# Altium schematic sheet 0016_Processor - PM , C.SchDoc
size A2
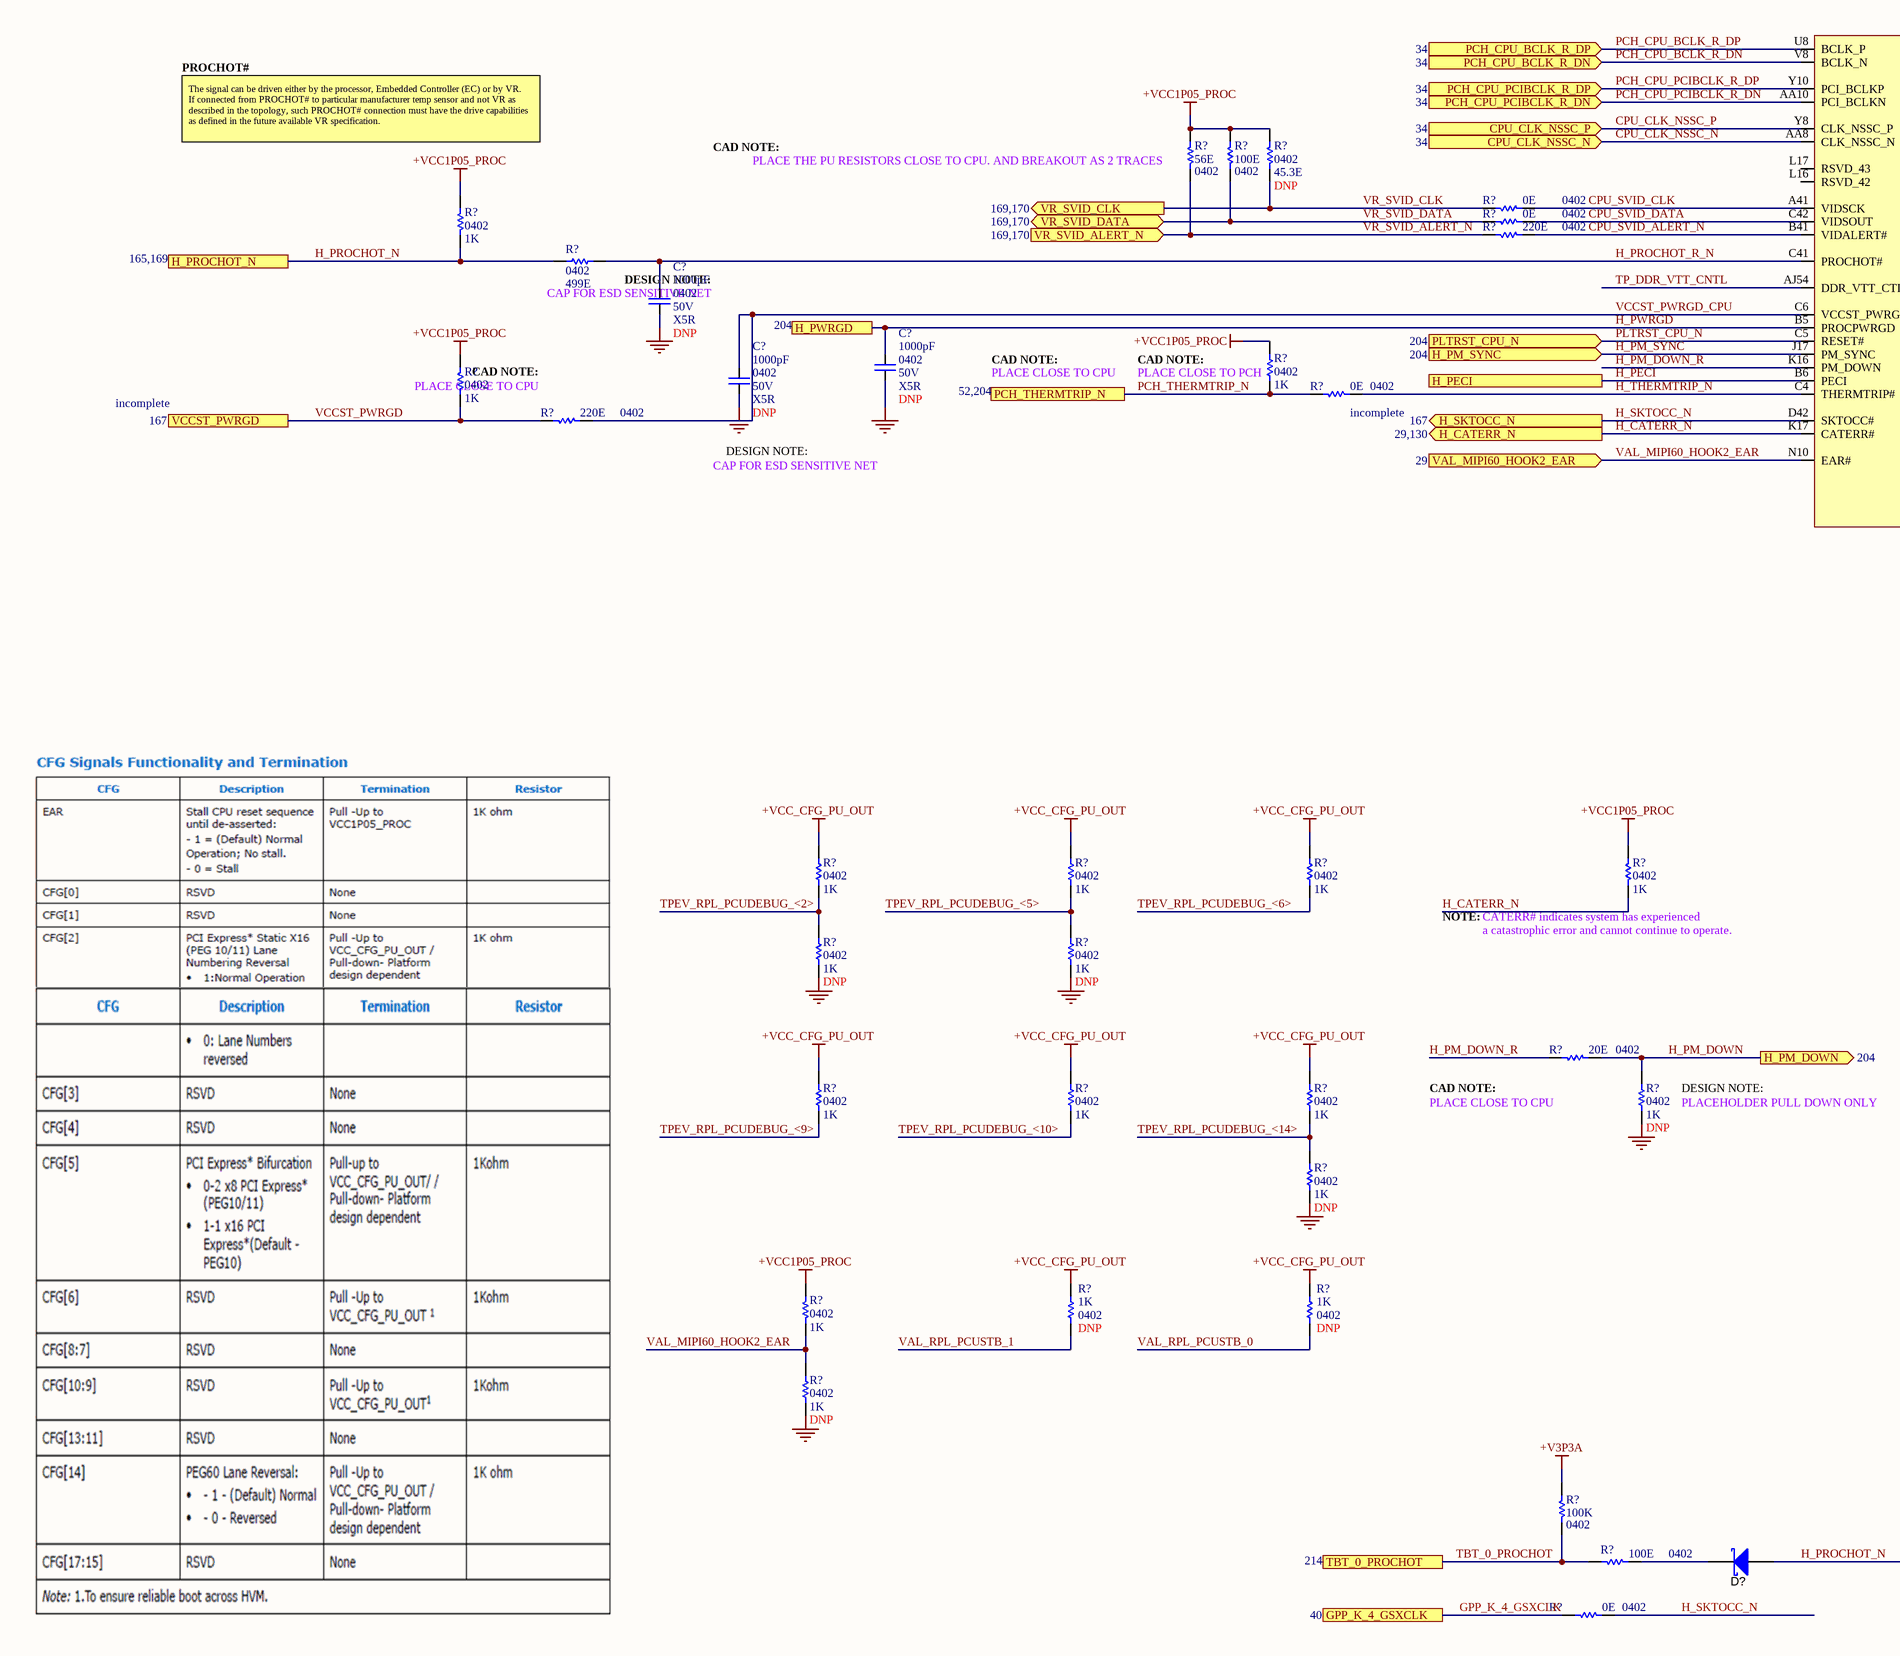
[diagram p0: 0016_Processor - PM , C.SchDoc, left]
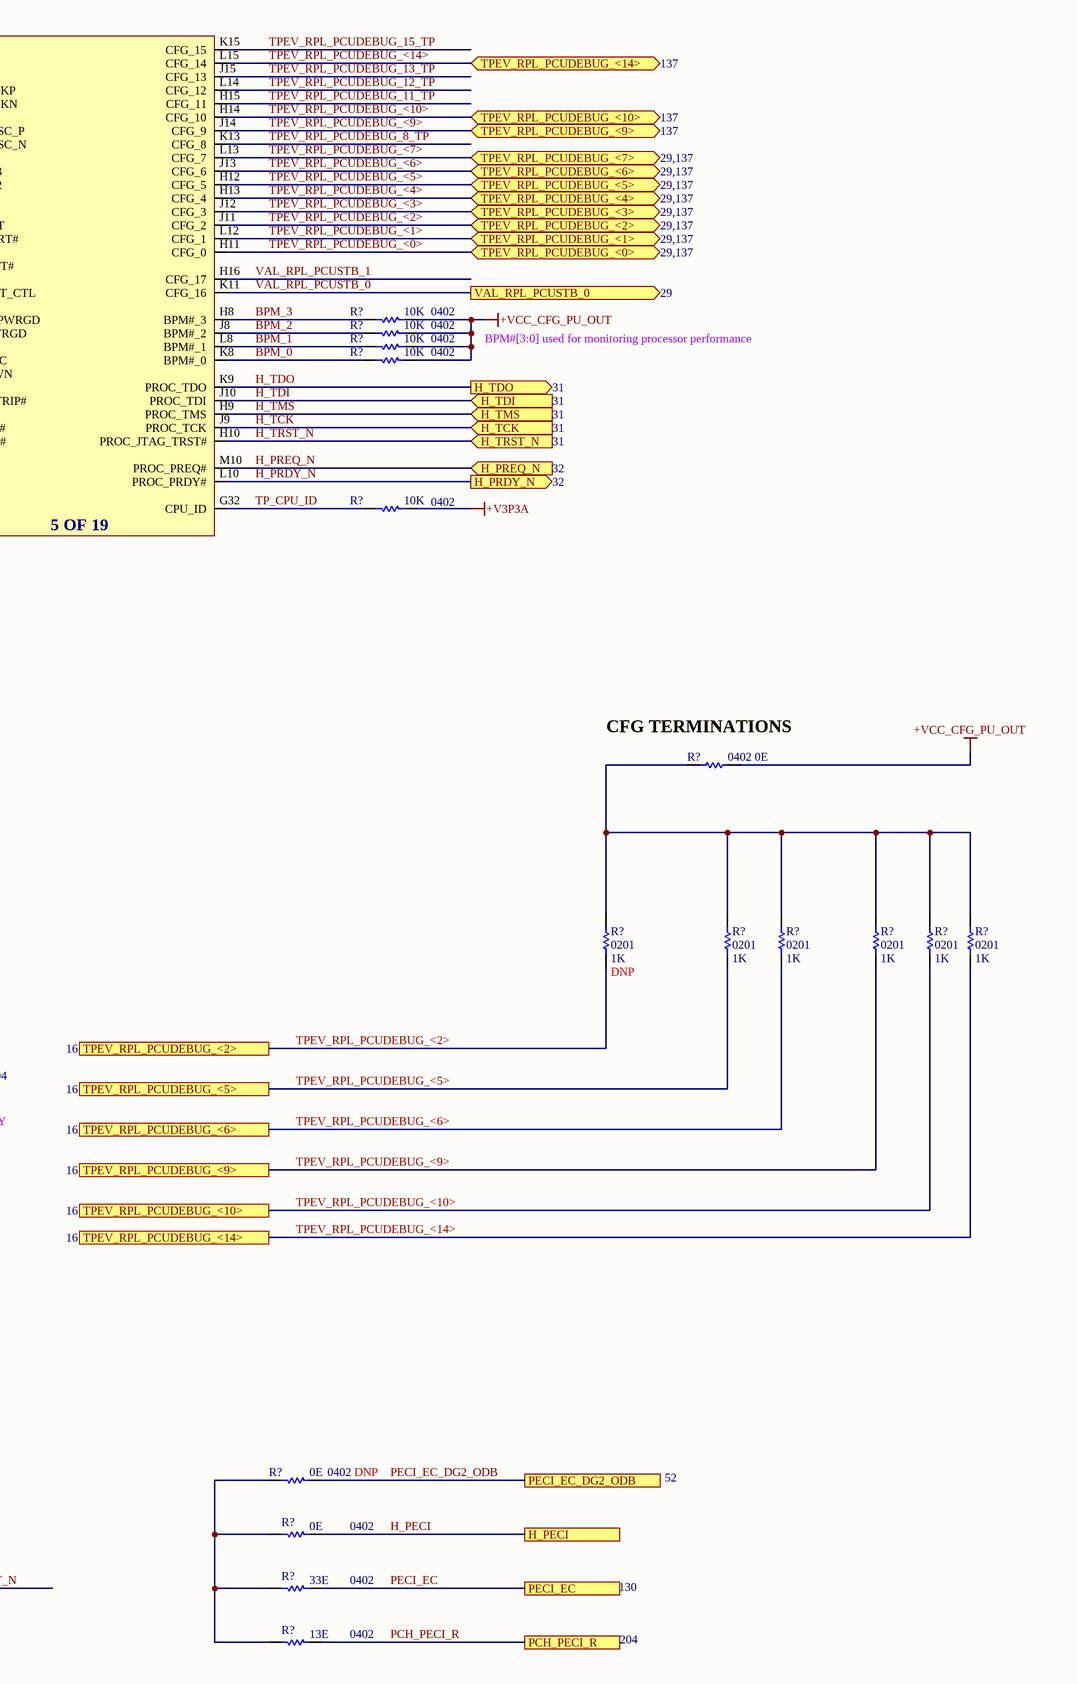
[diagram p1: 0016_Processor - PM , C.SchDoc, right]

## Parts
(Parts that share a designator on the sheet are numbered #1, #2 ... from top to bottom, then left to right.)
C?#1  value 1000pF  Case/Package: 0402  Voltage: 50V  Dielectric: X5R  [CAPC0402]
C?#2  value 1000pF  Case/Package: 0402  Voltage: 50V  Dielectric: X5R  [CAPC0402]
C?#3  value 1000pF  Case/Package: 0402  Voltage: 50V  Dielectric: X5R  [CAPC0402]
D?  SCHOTTKY  (value not drawn)
R?#1  value 56E  Case/Package: 0402  [RESC0402]  (hidden comment: Res)
R?#2  value 100E  Case/Package: 0402  [RESC0402]  (hidden comment: Res)
R?#3  value 45.3E  Case/Package: 0402  [RESC0402]  (hidden comment: Res)
R?#4  value 0E  Case/Package: 0402  [RESC0402]  (hidden comment: Res)
R?#5  value 1K  Case/Package: 0402  [RESC0402]  (hidden comment: Res)
R?#6  value 0E  Case/Package: 0402  [RESC0402]  (hidden comment: Res)
R?#7  value 220E  Case/Package: 0402  [RESC0402]  (hidden comment: Res)
R?#8  value 499E  Case/Package: 0402  [RESC0402]  (hidden comment: Res)
R?#9  value 10K  Case/Package: 0402  [RESC0402]  (hidden comment: Res)
R?#10  value 10K  Case/Package: 0402  [RESC0402]  (hidden comment: Res)
R?#11  value 10K  Case/Package: 0402  [RESC0402]  (hidden comment: Res)
R?#12  value 10K  Case/Package: 0402  [RESC0402]  (hidden comment: Res)
R?#13  value 1K  Case/Package: 0402  [RESC0402]  (hidden comment: Res)
R?#14  value 1K  Case/Package: 0402  [RESC0402]  (hidden comment: Res)
R?#15  value 0E  Case/Package: 0402  [RESC0402]  (hidden comment: Res)
R?#16  value 220E  Case/Package: 0402  [RESC0402]  (hidden comment: Res)
R?#17  value 10K  Case/Package: 0402  [RESC0402]  (hidden comment: Res)
R?#18  value 0E  Case/Package: 0402  [RESC0402]  (hidden comment: Res)
R?#19  value 1K  Case/Package: 0402  [RESC0402]  (hidden comment: Res)
R?#20  value 1K  Case/Package: 0402  [RESC0402]  (hidden comment: Res)
R?#21  value 1K  Case/Package: 0402  [RESC0402]  (hidden comment: Res)
R?#22  value 1K  Case/Package: 0402  [RESC0402]  (hidden comment: Res)
R?#23  value 1K  Case/Package: 0201  [RESC0201]  (hidden comment: Res)
R?#24  value 1K  Case/Package: 0201  [RESC0201]  (hidden comment: Res)
R?#25  value 1K  Case/Package: 0201  [RESC0201]  (hidden comment: Res)
R?#26  value 1K  Case/Package: 0201  [RESC0201]  (hidden comment: Res)
R?#27  value 1K  Case/Package: 0201  [RESC0201]  (hidden comment: Res)
R?#28  value 1K  Case/Package: 0201  [RESC0201]  (hidden comment: Res)
R?#29  value 1K  Case/Package: 0402  [RESC0402]  (hidden comment: Res)
R?#30  value 1K  Case/Package: 0402  [RESC0402]  (hidden comment: Res)
R?#31  value 20E  Case/Package: 0402  [RESC0402]  (hidden comment: Res)
R?#32  value 1K  Case/Package: 0402  [RESC0402]  (hidden comment: Res)
R?#33  value 1K  Case/Package: 0402  [RESC0402]  (hidden comment: Res)
R?#34  value 1K  Case/Package: 0402  [RESC0402]  (hidden comment: Res)
R?#35  value 1K  Case/Package: 0402  [RESC0402]  (hidden comment: Res)
R?#36  value 1K  Case/Package: 0402  [RESC0402]  (hidden comment: Res)
R?#37  value 1K  Case/Package: 0402  [RESC0402]  (hidden comment: Res)
R?#38  value 1K  Case/Package: 0402  [RESC0402]  (hidden comment: Res)
R?#39  value 1K  Case/Package: 0402  [RESC0402]  (hidden comment: Res)
R?#40  value 1K  Case/Package: 0402  [RESC0402]  (hidden comment: Res)
R?#41  value 0E  Case/Package: 0402  [RESC0402]  (hidden comment: Res)
R?#42  value 100K  Case/Package: 0402  [RESC0402]  (hidden comment: Res)
R?#43  value 0E  Case/Package: 0402  [RESC0402]  (hidden comment: Res)
R?#44  value 100E  Case/Package: 0402  [RESC0402]  (hidden comment: Res)
R?#45  value 33E  Case/Package: 0402  [RESC0402]  (hidden comment: Res)
R?#46  value 0E  Case/Package: 0402  [RESC0402]  (hidden comment: Res)
R?#47  value 13E  Case/Package: 0402  [RESC0402]  (hidden comment: Res)
U?  C_RPL_HX_EXT  (value not drawn)  (part E of 19)

## Ports
CPU_CLK_NSSC_N (in), CPU_CLK_NSSC_P (in), GPP_K_4_GSXCLK, H_CATERR_N (out), H_PECI, H_PM_DOWN (out), H_PM_SYNC (in), H_PRDY_N (out), H_PREQ_N (in), H_PROCHOT_N, H_PWRGD, H_SKTOCC_N (out), H_TCK (in), H_TDI (in), H_TDO (out), H_TMS (in), H_TRST_N (in), PCH_CPU_BCLK_R_DN (in), PCH_CPU_BCLK_R_DP (in), PCH_CPU_PCIBCLK_R_DN (in), PCH_CPU_PCIBCLK_R_DP (in), PCH_PECI_R, PCH_THERMTRIP_N, PECI_EC, PECI_EC_DG2_ODB, PLTRST_CPU_N (in), TBT_0_PROCHOT, TPEV_RPL_PCUDEBUG_<0> (bidir), TPEV_RPL_PCUDEBUG_<1> (bidir), TPEV_RPL_PCUDEBUG_<2>, TPEV_RPL_PCUDEBUG_<2> (bidir), TPEV_RPL_PCUDEBUG_<3> (bidir), TPEV_RPL_PCUDEBUG_<4> (bidir), TPEV_RPL_PCUDEBUG_<5>, TPEV_RPL_PCUDEBUG_<5> (bidir), TPEV_RPL_PCUDEBUG_<6>, TPEV_RPL_PCUDEBUG_<6> (bidir), TPEV_RPL_PCUDEBUG_<7> (bidir), TPEV_RPL_PCUDEBUG_<9>, TPEV_RPL_PCUDEBUG_<9> (bidir), TPEV_RPL_PCUDEBUG_<10>, TPEV_RPL_PCUDEBUG_<10> (bidir), TPEV_RPL_PCUDEBUG_<14>, TPEV_RPL_PCUDEBUG_<14> (bidir), VAL_MIPI60_HOOK2_EAR (in), VAL_RPL_PCUSTB_0 (out), VCCST_PWRGD, VR_SVID_ALERT_N (in), VR_SVID_CLK (out), VR_SVID_DATA (bidir)

## Nets
+V3P3A: R?#17.2 R?#42.2
+VCC1P05_PROC: R?#1.2 R?#2.2 R?#3.2 R?#5.1 R?#13.1 R?#14.1 R?#22.2 R?#37.1
+VCC_CFG_PU_OUT: R?#9.2 R?#10.2 R?#11.2 R?#12.2 R?#18.1 R?#19.2 R?#20.2 R?#21.2 R?#32.2 R?#33.2 R?#34.2 R?#38.2 R?#39.2
GND: C?#1.2 C?#2.2 C?#3.2 R?#29.1 R?#30.1 R?#35.2 R?#36.1 R?#40.2
BPM_0: R?#12.1 U?.K8(BPM#_0)
BPM_1: R?#11.1 U?.L8(BPM#_1)
BPM_2: R?#10.1 U?.J8(BPM#_2)
BPM_3: R?#9.1 U?.H8(BPM#_3)
CPU_CLK_NSSC_N: U?.AA8(CLK_NSSC_N) ; port CPU_CLK_NSSC_N
CPU_CLK_NSSC_P: U?.Y8(CLK_NSSC_P) ; port CPU_CLK_NSSC_P
CPU_SVID_ALERT_N: R?#7.2 U?.B41(VIDALERT#)
CPU_SVID_CLK: R?#4.2 U?.A41(VIDSCK)
CPU_SVID_DATA: R?#6.2 U?.C42(VIDSOUT)
GPP_K_4_GSXCLK: R?#46.1 ; port GPP_K_4_GSXCLK
H_CATERR_N: R?#22.1 U?.K17(CATERR#) ; port H_CATERR_N
H_PECI: R?#43.1 U?.B6(PECI) ; port H_PECI
H_PM_DOWN: R?#31.2 R?#35.1 ; port H_PM_DOWN
H_PM_DOWN_R: R?#31.1 U?.K16(PM_DOWN)
H_PM_SYNC: U?.J17(PM_SYNC) ; port H_PM_SYNC
H_PRDY_N: U?.L10(PROC_PRDY#) ; port H_PRDY_N
H_PREQ_N: U?.M10(PROC_PREQ#) ; port H_PREQ_N
H_PROCHOT_N: D?.A R?#5.2 R?#8.2 ; port H_PROCHOT_N
H_PROCHOT_R_N: C?#1.1 R?#8.1 U?.C41(PROCHOT#)
H_PWRGD: C?#2.1 U?.B5(PROCPWRGD) ; port H_PWRGD
H_SKTOCC_N: R?#46.2 U?.D42(SKTOCC#) ; port H_SKTOCC_N
H_TCK: U?.J9(PROC_TCK) ; port H_TCK
H_TDI: U?.J10(PROC_TDI) ; port H_TDI
H_TDO: U?.K9(PROC_TDO) ; port H_TDO
H_THERMTRIP_N: R?#15.2 U?.C4(THERMTRIP#)
H_TMS: U?.H9(PROC_TMS) ; port H_TMS
H_TRST_N: U?.H10(PROC_JTAG_TRST#) ; port H_TRST_N
PCH_CPU_BCLK_R_DN: U?.V8(BCLK_N) ; port PCH_CPU_BCLK_R_DN
PCH_CPU_BCLK_R_DP: U?.U8(BCLK_P) ; port PCH_CPU_BCLK_R_DP
PCH_CPU_PCIBCLK_R_DN: U?.AA10(PCI_BCLKN) ; port PCH_CPU_PCIBCLK_R_DN
PCH_CPU_PCIBCLK_R_DP: U?.Y10(PCI_BCLKP) ; port PCH_CPU_PCIBCLK_R_DP
PCH_PECI_R: R?#47.1 ; port PCH_PECI_R
PCH_THERMTRIP_N: R?#13.2 R?#15.1 ; port PCH_THERMTRIP_N
PECI_EC: R?#45.1 ; port PECI_EC
PECI_EC_DG2_ODB: R?#41.1 ; port PECI_EC_DG2_ODB
PLTRST_CPU_N: U?.C5(RESET#) ; port PLTRST_CPU_N
TBT_0_PROCHOT: R?#42.1 R?#44.2 ; port TBT_0_PROCHOT
TP_CPU_ID: R?#17.1 U?.G32(CPU_ID)
TP_DDR_VTT_CNTL: U?.AJ54(DDR_VTT_CTL)
TPEV_RPL_PCUDEBUG_8_TP: U?.K13(CFG_8)
TPEV_RPL_PCUDEBUG_11_TP: U?.H15(CFG_11)
TPEV_RPL_PCUDEBUG_12_TP: U?.L14(CFG_12)
TPEV_RPL_PCUDEBUG_13_TP: U?.J15(CFG_13)
TPEV_RPL_PCUDEBUG_15_TP: U?.K15(CFG_15)
TPEV_RPL_PCUDEBUG_<0>: U?.H11(CFG_0) ; port TPEV_RPL_PCUDEBUG_<0>
TPEV_RPL_PCUDEBUG_<1>: U?.L12(CFG_1) ; port TPEV_RPL_PCUDEBUG_<1>
TPEV_RPL_PCUDEBUG_<2>: R?#19.1 R?#23.1 R?#29.2 U?.J11(CFG_2) ; port TPEV_RPL_PCUDEBUG_<2>
TPEV_RPL_PCUDEBUG_<3>: U?.J12(CFG_3) ; port TPEV_RPL_PCUDEBUG_<3>
TPEV_RPL_PCUDEBUG_<4>: U?.H13(CFG_4) ; port TPEV_RPL_PCUDEBUG_<4>
TPEV_RPL_PCUDEBUG_<5>: R?#20.1 R?#24.1 R?#30.2 U?.H12(CFG_5) ; port TPEV_RPL_PCUDEBUG_<5>
TPEV_RPL_PCUDEBUG_<6>: R?#21.1 R?#25.1 U?.J13(CFG_6) ; port TPEV_RPL_PCUDEBUG_<6>
TPEV_RPL_PCUDEBUG_<7>: U?.L13(CFG_7) ; port TPEV_RPL_PCUDEBUG_<7>
TPEV_RPL_PCUDEBUG_<9>: R?#26.1 R?#32.1 U?.J14(CFG_9) ; port TPEV_RPL_PCUDEBUG_<9>
TPEV_RPL_PCUDEBUG_<10>: R?#27.1 R?#33.1 U?.H14(CFG_10) ; port TPEV_RPL_PCUDEBUG_<10>
TPEV_RPL_PCUDEBUG_<14>: R?#28.1 R?#34.1 R?#36.2 U?.L15(CFG_14) ; port TPEV_RPL_PCUDEBUG_<14>
VAL_MIPI60_HOOK2_EAR: R?#37.2 R?#40.1 U?.N10(EAR#) ; port VAL_MIPI60_HOOK2_EAR
VAL_RPL_PCUSTB_0: R?#39.1 U?.K11(CFG_16) ; port VAL_RPL_PCUSTB_0
VAL_RPL_PCUSTB_1: R?#38.1 U?.H16(CFG_17)
VCCST_PWRGD: R?#14.2 R?#16.1 ; port VCCST_PWRGD
VCCST_PWRGD_CPU: C?#3.1 R?#16.2 U?.C6(VCCST_PWRGD)
VR_SVID_ALERT_N: R?#1.1 R?#7.1 ; port VR_SVID_ALERT_N
VR_SVID_CLK: R?#3.1 R?#4.1 ; port VR_SVID_CLK
VR_SVID_DATA: R?#2.1 R?#6.1 ; port VR_SVID_DATA
NetD?_K: D?.K R?#44.1
NetR?#18_2: R?#18.2 R?#23.2 R?#24.2 R?#25.2 R?#26.2 R?#27.2 R?#28.2
NetR?#41_2: R?#41.2 R?#43.2 R?#45.2 R?#47.2

Not connected (* = marked no-connect by the designer): U? L16(RSVD_42) L17(RSVD_43)

## Notes on the sheet
- PROCHOT#
- The signal can be driven either by the processor, Embedded Controller (EC) or by VR.
  If connected from PROCHOT# to particular manufacturer temp sensor and not VR as
  described in the topology, such PROCHOT# connection must have the drive capabilities
  as defined in the future available VR specification.
- CAD NOTE:
- PLACE THE PU RESISTORS CLOSE TO CPU. AND BREAKOUT AS 2 TRACES
- DESIGN NOTE:
- CAP FOR ESD SENSITIVE NET
- BPM#[3:0] used for monitoring processor performance
- incomplete
- (near R?#16) CAD NOTE:
- (near R?#16) PLACE CLOSE TO CPU
- PLACE CLOSE TO CPU
- (near R?#13) PLACE CLOSE TO PCH
- (near R?#15) incomplete
- (near R?#18) CFG TERMINATIONS
- NOTE:
- (near R?#22) CATERR# indicates system has experienced
- (near R?#22) a catastrophic error and cannot continue to operate.
- (near R?#31) PLACE CLOSE TO CPU
- (near R?#35) DESIGN NOTE:
- (near R?#35) PLACEHOLDER PULL DOWN ONLY
- (in symbol C_RPL_HX_EXT, part E) 5 OF 19

## Library data of the parts
C?#1-C?#3 = Cap: CAP CER 1000pF 50V X5R 0402; DNP: DNP
D? = SCHOTTKY: Diode, Schottky, 40V, 5A, SMC; ComponentLink1Description: Datasheet link; ComponentLink1URL: http://www.comchip.com.tw/cms/UserFiles/QW-BB012%20CDBC520-G%7E5100-G%20RevC809622.pdf; Manufacturer Part Number: *; Case/Package: *
R?#1 = Res: Thick Film Resistor -  56ohm, 1%, 0402
R?#2 R?#44 = Res: Thick Film Resistor -  100ohm, 1%, 0402
R?#3 = Res: Thick Film Resistor -  45.3ohm, 1%, 0402; DNP: DNP
R?#4 R?#6 R?#15 R?#18 R?#41 R?#43 R?#46 = Res: Thick Film Resistor -  0ohm, 1%, 0402
  R?#41: DNP: DNP
R?#5 R?#13 R?#14 R?#19-R?#22 R?#29 R?#30 R?#32-R?#40 = Res: Thick Film Resistor -  1Kohm, 1%, 0402
  R?#29 R?#30 R?#35 R?#36 R?#38-R?#40: DNP: DNP
R?#7 R?#16 = Res: Thick Film Resistor -  220ohm, 1%, 0402
R?#8 = Res: Thick Film Resistor -  499ohm, 1%, 0402
R?#9-R?#12 R?#17 = Res: Thick Film Resistor -  10Kohm, 1%, 0402
R?#23-R?#28 = Res: Thick Film Resistor -  1Kohm, 1%, 0201
  R?#23: DNP: DNP
R?#31 = Res: Thick Film Resistor -  20ohm, 1%, 0402
R?#42 = Res: Thick Film Resistor -  100Kohm, 1%, 0402
R?#45 = Res: Thick Film Resistor -  33ohm, 0.05%, 0402
R?#47 = Res: Thick Film Resistor -  13ohm, 0.05%, 0402